# EAGLE schematic Resistor_Resistor (EAGLE 8.3.0), part 13 of 43
## Parts (continued)
R17338  10K  RESISTOR_0201  [0201]
R17339  10K  RESISTOR_0201  [0201]
R17340  10K  RESISTOR_0201  [0201]
R17341  10K  RESISTOR_0201  [0201]
R17342  10K  RESISTOR_0201  [0201]
R17343  10K  RESISTOR_0201  [0201]
R17344  10K  RESISTOR_0201  [0201]
R17345  10K  RESISTOR_0201  [0201]
R17346  10K  RESISTOR_0201  [0201]
R17347  10K  RESISTOR_0201  [0201]
R17348  10K  RESISTOR_0201  [0201]
R17349  10K  RESISTOR_0201  [0201]
R17350  10K  RESISTOR_0201  [0201]
R17351  10K  RESISTOR_0201  [0201]
R17352  10K  RESISTOR_0201  [0201]
R17353  10K  RESISTOR_0201  [0201]
R17354  10K  RESISTOR_0201  [0201]
R17355  10K  RESISTOR_0201  [0201]
R17356  10K  RESISTOR_0201  [0201]
R17357  10K  RESISTOR_0201  [0201]
R17358  10K  RESISTOR_0201  [0201]
R17359  10K  RESISTOR_0201  [0201]
R17360  10K  RESISTOR_0201  [0201]
R17361  10K  RESISTOR_0201  [0201]
R17362  10K  RESISTOR_0201  [0201]
R17363  10K  RESISTOR_0201  [0201]
R17364  10K  RESISTOR_0201  [0201]
R17365  10K  RESISTOR_0201  [0201]
R17366  10K  RESISTOR_0201  [0201]
R17367  10K  RESISTOR_0201  [0201]
R17368  10K  RESISTOR_0201  [0201]
R17369  10K  RESISTOR_0201  [0201]
R17370  10K  RESISTOR_0201  [0201]
R17371  10K  RESISTOR_0201  [0201]
R17372  10K  RESISTOR_0201  [0201]
R17373  10K  RESISTOR_0201  [0201]
R17374  10K  RESISTOR_0201  [0201]
R17375  10K  RESISTOR_0201  [0201]
R17376  10K  RESISTOR_0201  [0201]
R17377  10K  RESISTOR_0201  [0201]
R17378  10K  RESISTOR_0201  [0201]
R17379  10K  RESISTOR_0201  [0201]
R17380  10K  RESISTOR_0201  [0201]
R17381  10K  RESISTOR_0201  [0201]
R17382  10K  RESISTOR_0201  [0201]
R17383  10K  RESISTOR_0201  [0201]
R17384  10K  RESISTOR_0201  [0201]
R17385  10K  RESISTOR_0201  [0201]
R17386  10K  RESISTOR_0201  [0201]
R17387  10K  RESISTOR_0201  [0201]
R17388  10K  RESISTOR_0201  [0201]
R17389  10K  RESISTOR_0201  [0201]
R17390  10K  RESISTOR_0201  [0201]
R17391  10K  RESISTOR_0201  [0201]
R17392  10K  RESISTOR_0201  [0201]
R17393  10K  RESISTOR_0201  [0201]
R17394  10K  RESISTOR_0201  [0201]
R17395  10K  RESISTOR_0201  [0201]
R17396  10K  RESISTOR_0201  [0201]
R17397  10K  RESISTOR_0201  [0201]
R17398  10K  RESISTOR_0201  [0201]
R17399  10K  RESISTOR_0201  [0201]
R17400  10K  RESISTOR_0201  [0201]
R17401  10K  RESISTOR_0201  [0201]
R17402  10K  RESISTOR_0201  [0201]
R17403  10K  RESISTOR_0201  [0201]
R17404  10K  RESISTOR_0201  [0201]
R17405  10K  RESISTOR_0201  [0201]
R17406  10K  RESISTOR_0201  [0201]
R17407  10K  RESISTOR_0201  [0201]
R17408  10K  RESISTOR_0201  [0201]
R17409  10K  RESISTOR_0201  [0201]
R17410  10K  RESISTOR_0201  [0201]
R17411  10K  RESISTOR_0201  [0201]
R17412  10K  RESISTOR_0201  [0201]
R17413  10K  RESISTOR_0201  [0201]
R17414  10K  RESISTOR_0201  [0201]
R17415  10K  RESISTOR_0201  [0201]
R17416  10K  RESISTOR_0201  [0201]
R17417  10K  RESISTOR_0201  [0201]
R17418  10K  RESISTOR_0201  [0201]
R17419  10K  RESISTOR_0201  [0201]
R17420  10K  RESISTOR_0201  [0201]
R17421  10K  RESISTOR_0201  [0201]
R17422  10K  RESISTOR_0201  [0201]
R17423  10K  RESISTOR_0201  [0201]
R17424  10K  RESISTOR_0201  [0201]
R17425  10K  RESISTOR_0201  [0201]
R17426  10K  RESISTOR_0201  [0201]
R17427  10K  RESISTOR_0201  [0201]
R17428  10K  RESISTOR_0201  [0201]
R17429  10K  RESISTOR_0201  [0201]
R17430  10K  RESISTOR_0201  [0201]
R17431  10K  RESISTOR_0201  [0201]
R17432  10K  RESISTOR_0201  [0201]
R17433  10K  RESISTOR_0201  [0201]
R17434  10K  RESISTOR_0201  [0201]
R17435  10K  RESISTOR_0201  [0201]
R17436  10K  RESISTOR_0201  [0201]
R17437  10K  RESISTOR_0201  [0201]
R17438  10K  RESISTOR_0201  [0201]
R17439  10K  RESISTOR_0201  [0201]
R17440  10K  RESISTOR_0201  [0201]
R17441  10K  RESISTOR_0201  [0201]
R17442  10K  RESISTOR_0201  [0201]
R17443  10K  RESISTOR_0201  [0201]
R17444  10K  RESISTOR_0201  [0201]
R17445  10K  RESISTOR_0201  [0201]
R17446  10K  RESISTOR_0201  [0201]
R17447  10K  RESISTOR_0201  [0201]
R17448  10K  RESISTOR_0201  [0201]
R17449  10K  RESISTOR_0201  [0201]
R17450  10K  RESISTOR_0201  [0201]
R17451  10K  RESISTOR_0201  [0201]
R17452  10K  RESISTOR_0201  [0201]
R17453  10K  RESISTOR_0201  [0201]
R17454  10K  RESISTOR_0201  [0201]
R17455  10K  RESISTOR_0201  [0201]
R17456  10K  RESISTOR_0201  [0201]
R17457  10K  RESISTOR_0201  [0201]
R17458  10K  RESISTOR_0201  [0201]
R17459  10K  RESISTOR_0201  [0201]
R17460  10K  RESISTOR_0201  [0201]
R17461  10K  RESISTOR_0201  [0201]
R17462  10K  RESISTOR_0201  [0201]
R17463  10K  RESISTOR_0201  [0201]
R17464  10K  RESISTOR_0201  [0201]
R17465  10K  RESISTOR_0201  [0201]
R17466  10K  RESISTOR_0201  [0201]
R17467  10K  RESISTOR_0201  [0201]
R17468  10K  RESISTOR_0201  [0201]
R17469  10K  RESISTOR_0201  [0201]
R17470  10K  RESISTOR_0201  [0201]
R17471  10K  RESISTOR_0201  [0201]
R17472  10K  RESISTOR_0201  [0201]
R17473  10K  RESISTOR_0201  [0201]
R17474  10K  RESISTOR_0201  [0201]
R17475  10K  RESISTOR_0201  [0201]
R17476  10K  RESISTOR_0201  [0201]
R17477  10K  RESISTOR_0201  [0201]
R17478  10K  RESISTOR_0201  [0201]
R17479  10K  RESISTOR_0201  [0201]
R17480  10K  RESISTOR_0201  [0201]
R17481  10K  RESISTOR_0201  [0201]
R17482  10K  RESISTOR_0201  [0201]
R17483  10K  RESISTOR_0201  [0201]
R17484  10K  RESISTOR_0201  [0201]
R17485  10K  RESISTOR_0201  [0201]
R17486  10K  RESISTOR_0201  [0201]
R17487  10K  RESISTOR_0201  [0201]
R17488  10K  RESISTOR_0201  [0201]
R17489  10K  RESISTOR_0201  [0201]
R17490  10K  RESISTOR_0201  [0201]
R17491  10K  RESISTOR_0201  [0201]
R17492  10K  RESISTOR_0201  [0201]
R17493  10K  RESISTOR_0201  [0201]
R17494  10K  RESISTOR_0201  [0201]
R17495  10K  RESISTOR_0201  [0201]
R17496  10K  RESISTOR_0201  [0201]
R17497  10K  RESISTOR_0201  [0201]
R17498  10K  RESISTOR_0201  [0201]
R17499  10K  RESISTOR_0201  [0201]
R17500  10K  RESISTOR_0201  [0201]
R17501  10K  RESISTOR_0201  [0201]
R17502  10K  RESISTOR_0201  [0201]
R17503  10K  RESISTOR_0201  [0201]
R17504  10K  RESISTOR_0201  [0201]
R17505  10K  RESISTOR_0201  [0201]
R17506  10K  RESISTOR_0201  [0201]
R17507  10K  RESISTOR_0201  [0201]
R17508  10K  RESISTOR_0201  [0201]
R17509  10K  RESISTOR_0201  [0201]
R17510  10K  RESISTOR_0201  [0201]
R17511  10K  RESISTOR_0201  [0201]
R17512  10K  RESISTOR_0201  [0201]
R17513  10K  RESISTOR_0201  [0201]
R17514  10K  RESISTOR_0201  [0201]
R17515  10K  RESISTOR_0201  [0201]
R17516  10K  RESISTOR_0201  [0201]
R17517  10K  RESISTOR_0201  [0201]
R17518  10K  RESISTOR_0201  [0201]
R17519  10K  RESISTOR_0201  [0201]
R17520  10K  RESISTOR_0201  [0201]
R17521  10K  RESISTOR_0201  [0201]
R17522  10K  RESISTOR_0201  [0201]
R17523  10K  RESISTOR_0201  [0201]
R17524  10K  RESISTOR_0201  [0201]
R17525  10K  RESISTOR_0201  [0201]
R17526  10K  RESISTOR_0201  [0201]
R17527  10K  RESISTOR_0201  [0201]
R17528  10K  RESISTOR_0201  [0201]
R17529  10K  RESISTOR_0201  [0201]
R17530  10K  RESISTOR_0201  [0201]
R17531  10K  RESISTOR_0201  [0201]
R17532  10K  RESISTOR_0201  [0201]
R17533  10K  RESISTOR_0201  [0201]
R17534  10K  RESISTOR_0201  [0201]
R17535  10K  RESISTOR_0201  [0201]
R17536  10K  RESISTOR_0201  [0201]
R17537  10K  RESISTOR_0201  [0201]
R17538  10K  RESISTOR_0201  [0201]
R17539  10K  RESISTOR_0201  [0201]
R17540  10K  RESISTOR_0201  [0201]
R17541  10K  RESISTOR_0201  [0201]
R17542  10K  RESISTOR_0201  [0201]
R17543  10K  RESISTOR_0201  [0201]
R17544  10K  RESISTOR_0201  [0201]
R17545  10K  RESISTOR_0201  [0201]
R17546  10K  RESISTOR_0201  [0201]
R17547  10K  RESISTOR_0201  [0201]
R17548  10K  RESISTOR_0201  [0201]
R17549  10K  RESISTOR_0201  [0201]
R17550  10K  RESISTOR_0201  [0201]
R17551  10K  RESISTOR_0201  [0201]
R17552  10K  RESISTOR_0201  [0201]
R17553  10K  RESISTOR_0201  [0201]
R17554  10K  RESISTOR_0201  [0201]
R17555  10K  RESISTOR_0201  [0201]
R17556  10K  RESISTOR_0201  [0201]
R17557  10K  RESISTOR_0201  [0201]
R17558  10K  RESISTOR_0201  [0201]
R17559  10K  RESISTOR_0201  [0201]
R17560  10K  RESISTOR_0201  [0201]
R17561  10K  RESISTOR_0201  [0201]
R17562  10K  RESISTOR_0201  [0201]
R17563  10K  RESISTOR_0201  [0201]
R17564  10K  RESISTOR_0201  [0201]
R17565  10K  RESISTOR_0201  [0201]
R17566  10K  RESISTOR_0201  [0201]
R17567  10K  RESISTOR_0201  [0201]
R17568  10K  RESISTOR_0201  [0201]
R17569  10K  RESISTOR_0201  [0201]
R17570  10K  RESISTOR_0201  [0201]
R17571  10K  RESISTOR_0201  [0201]
R17572  10K  RESISTOR_0201  [0201]
R17573  10K  RESISTOR_0201  [0201]
R17574  10K  RESISTOR_0201  [0201]
R17575  10K  RESISTOR_0201  [0201]
R17576  10K  RESISTOR_0201  [0201]
R17577  10K  RESISTOR_0201  [0201]
R17578  10K  RESISTOR_0201  [0201]
R17579  10K  RESISTOR_0201  [0201]
R17580  10K  RESISTOR_0201  [0201]
R17581  10K  RESISTOR_0201  [0201]
R17582  10K  RESISTOR_0201  [0201]
R17583  10K  RESISTOR_0201  [0201]
R17584  10K  RESISTOR_0201  [0201]
R17585  10K  RESISTOR_0201  [0201]
R17586  10K  RESISTOR_0201  [0201]
R17587  10K  RESISTOR_0201  [0201]
R17588  10K  RESISTOR_0201  [0201]
R17589  10K  RESISTOR_0201  [0201]
R17590  10K  RESISTOR_0201  [0201]
R17591  10K  RESISTOR_0201  [0201]
R17592  10K  RESISTOR_0201  [0201]
R17593  10K  RESISTOR_0201  [0201]
R17594  10K  RESISTOR_0201  [0201]
R17595  10K  RESISTOR_0201  [0201]
R17596  10K  RESISTOR_0201  [0201]
R17597  10K  RESISTOR_0201  [0201]
R17598  10K  RESISTOR_0201  [0201]
R17599  10K  RESISTOR_0201  [0201]
R17600  10K  RESISTOR_0201  [0201]
R17601  10K  RESISTOR_0201  [0201]
R17602  10K  RESISTOR_0201  [0201]
R17603  10K  RESISTOR_0201  [0201]
R17604  10K  RESISTOR_0201  [0201]
R17605  10K  RESISTOR_0201  [0201]
R17606  10K  RESISTOR_0201  [0201]
R17607  10K  RESISTOR_0201  [0201]
R17608  10K  RESISTOR_0201  [0201]
R17609  10K  RESISTOR_0201  [0201]
R17610  10K  RESISTOR_0201  [0201]
R17611  10K  RESISTOR_0201  [0201]
R17612  10K  RESISTOR_0201  [0201]
R17613  10K  RESISTOR_0201  [0201]
R17614  10K  RESISTOR_0201  [0201]
R17615  10K  RESISTOR_0201  [0201]
R17616  10K  RESISTOR_0201  [0201]
R17617  10K  RESISTOR_0201  [0201]
R17618  10K  RESISTOR_0201  [0201]
R17619  10K  RESISTOR_0201  [0201]
R17620  10K  RESISTOR_0201  [0201]
R17621  10K  RESISTOR_0201  [0201]
R17622  10K  RESISTOR_0201  [0201]
R17623  10K  RESISTOR_0201  [0201]
R17624  10K  RESISTOR_0201  [0201]
R17625  10K  RESISTOR_0201  [0201]
R17626  10K  RESISTOR_0201  [0201]
R17627  10K  RESISTOR_0201  [0201]
R17628  10K  RESISTOR_0201  [0201]
R17629  10K  RESISTOR_0201  [0201]
R17630  10K  RESISTOR_0201  [0201]
R17631  10K  RESISTOR_0201  [0201]
R17632  10K  RESISTOR_0201  [0201]
R17633  10K  RESISTOR_0201  [0201]
R17634  10K  RESISTOR_0201  [0201]
R17635  10K  RESISTOR_0201  [0201]
R17636  10K  RESISTOR_0201  [0201]
R17637  10K  RESISTOR_0201  [0201]
R17638  10K  RESISTOR_0201  [0201]
R17639  10K  RESISTOR_0201  [0201]
R17640  10K  RESISTOR_0201  [0201]
R17641  10K  RESISTOR_0201  [0201]
R17642  10K  RESISTOR_0201  [0201]
R17643  10K  RESISTOR_0201  [0201]
R17644  10K  RESISTOR_0201  [0201]
R17645  10K  RESISTOR_0201  [0201]
R17646  10K  RESISTOR_0201  [0201]
R17647  10K  RESISTOR_0201  [0201]
R17648  10K  RESISTOR_0201  [0201]
R17649  10K  RESISTOR_0201  [0201]
R17650  10K  RESISTOR_0201  [0201]
R17651  10K  RESISTOR_0201  [0201]
R17652  10K  RESISTOR_0201  [0201]
R17653  10K  RESISTOR_0201  [0201]
R17654  10K  RESISTOR_0201  [0201]
R17655  10K  RESISTOR_0201  [0201]
R17656  10K  RESISTOR_0201  [0201]
R17657  10K  RESISTOR_0201  [0201]
R17658  10K  RESISTOR_0201  [0201]
R17659  10K  RESISTOR_0201  [0201]
R17660  10K  RESISTOR_0201  [0201]
R17661  10K  RESISTOR_0201  [0201]
R17662  10K  RESISTOR_0201  [0201]
R17663  10K  RESISTOR_0201  [0201]
R17664  10K  RESISTOR_0201  [0201]
R17665  10K  RESISTOR_0201  [0201]
R17666  10K  RESISTOR_0201  [0201]
R17667  10K  RESISTOR_0201  [0201]
R17668  10K  RESISTOR_0201  [0201]
R17669  10K  RESISTOR_0201  [0201]
R17670  10K  RESISTOR_0201  [0201]
R17671  10K  RESISTOR_0201  [0201]
R17672  10K  RESISTOR_0201  [0201]
R17673  10K  RESISTOR_0201  [0201]
R17674  10K  RESISTOR_0201  [0201]
R17675  10K  RESISTOR_0201  [0201]
R17676  10K  RESISTOR_0201  [0201]
R17677  10K  RESISTOR_0201  [0201]
R17678  10K  RESISTOR_0201  [0201]
R17679  10K  RESISTOR_0201  [0201]
R17680  10K  RESISTOR_0201  [0201]
R17681  10K  RESISTOR_0201  [0201]
R17682  10K  RESISTOR_0201  [0201]
R17683  10K  RESISTOR_0201  [0201]
R17684  10K  RESISTOR_0201  [0201]
R17685  10K  RESISTOR_0201  [0201]
R17686  10K  RESISTOR_0201  [0201]
R17687  10K  RESISTOR_0201  [0201]
R17688  10K  RESISTOR_0201  [0201]
R17689  10K  RESISTOR_0201  [0201]
R17690  10K  RESISTOR_0201  [0201]
R17691  10K  RESISTOR_0201  [0201]
R17692  10K  RESISTOR_0201  [0201]
R17693  10K  RESISTOR_0201  [0201]
R17694  10K  RESISTOR_0201  [0201]
R17695  10K  RESISTOR_0201  [0201]
R17696  10K  RESISTOR_0201  [0201]
R17697  10K  RESISTOR_0201  [0201]
R17698  10K  RESISTOR_0201  [0201]
R17699  10K  RESISTOR_0201  [0201]
R17700  10K  RESISTOR_0201  [0201]
R17701  10K  RESISTOR_0201  [0201]
R17702  10K  RESISTOR_0201  [0201]
R17703  10K  RESISTOR_0201  [0201]
R17704  10K  RESISTOR_0201  [0201]
R17705  10K  RESISTOR_0201  [0201]
R17706  10K  RESISTOR_0201  [0201]
R17707  10K  RESISTOR_0201  [0201]
R17708  10K  RESISTOR_0201  [0201]
R17709  10K  RESISTOR_0201  [0201]
R17710  10K  RESISTOR_0201  [0201]
R17711  10K  RESISTOR_0201  [0201]
R17712  10K  RESISTOR_0201  [0201]
R17713  10K  RESISTOR_0201  [0201]
R17714  10K  RESISTOR_0201  [0201]
R17715  10K  RESISTOR_0201  [0201]
R17716  10K  RESISTOR_0201  [0201]
R17717  10K  RESISTOR_0201  [0201]
R17718  10K  RESISTOR_0201  [0201]
R17719  10K  RESISTOR_0201  [0201]
R17720  10K  RESISTOR_0201  [0201]
R17721  10K  RESISTOR_0201  [0201]
R17722  10K  RESISTOR_0201  [0201]
R17723  10K  RESISTOR_0201  [0201]
R17724  10K  RESISTOR_0201  [0201]
R17725  10K  RESISTOR_0201  [0201]
R17726  10K  RESISTOR_0201  [0201]
R17727  10K  RESISTOR_0201  [0201]
R17728  10K  RESISTOR_0201  [0201]
R17729  10K  RESISTOR_0201  [0201]
R17730  10K  RESISTOR_0201  [0201]
R17731  10K  RESISTOR_0201  [0201]
R17732  10K  RESISTOR_0201  [0201]
R17733  10K  RESISTOR_0201  [0201]
R17734  10K  RESISTOR_0201  [0201]
R17735  10K  RESISTOR_0201  [0201]
R17736  10K  RESISTOR_0201  [0201]
R17737  10K  RESISTOR_0201  [0201]
R17738  10K  RESISTOR_0201  [0201]
R17739  10K  RESISTOR_0201  [0201]
R17740  10K  RESISTOR_0201  [0201]
R17741  10K  RESISTOR_0201  [0201]
R17742  10K  RESISTOR_0201  [0201]
R17743  10K  RESISTOR_0201  [0201]
R17744  10K  RESISTOR_0201  [0201]
R17745  10K  RESISTOR_0201  [0201]
R17746  10K  RESISTOR_0201  [0201]
R17747  10K  RESISTOR_0201  [0201]
R17748  10K  RESISTOR_0201  [0201]
R17749  10K  RESISTOR_0201  [0201]
R17750  10K  RESISTOR_0201  [0201]
R17751  10K  RESISTOR_0201  [0201]
R17752  10K  RESISTOR_0201  [0201]
R17753  10K  RESISTOR_0201  [0201]
R17754  10K  RESISTOR_0201  [0201]
R17755  10K  RESISTOR_0201  [0201]
R17756  10K  RESISTOR_0201  [0201]
R17757  10K  RESISTOR_0201  [0201]
R17758  10K  RESISTOR_0201  [0201]
R17759  10K  RESISTOR_0201  [0201]
R17760  10K  RESISTOR_0201  [0201]
R17761  10K  RESISTOR_0201  [0201]
R17762  10K  RESISTOR_0201  [0201]
R17763  10K  RESISTOR_0201  [0201]
R17764  10K  RESISTOR_0201  [0201]
R17765  10K  RESISTOR_0201  [0201]
R17766  10K  RESISTOR_0201  [0201]
R17767  10K  RESISTOR_0201  [0201]
R17768  10K  RESISTOR_0201  [0201]
R17769  10K  RESISTOR_0201  [0201]
R17770  10K  RESISTOR_0201  [0201]
R17771  10K  RESISTOR_0201  [0201]
R17772  10K  RESISTOR_0201  [0201]
R17773  10K  RESISTOR_0201  [0201]
R17774  10K  RESISTOR_0201  [0201]
R17775  10K  RESISTOR_0201  [0201]
R17776  10K  RESISTOR_0201  [0201]
R17777  10K  RESISTOR_0201  [0201]
R17778  10K  RESISTOR_0201  [0201]
R17779  10K  RESISTOR_0201  [0201]
R17780  10K  RESISTOR_0201  [0201]
R17781  10K  RESISTOR_0201  [0201]
R17782  10K  RESISTOR_0201  [0201]
R17783  10K  RESISTOR_0201  [0201]
R17784  10K  RESISTOR_0201  [0201]
R17785  10K  RESISTOR_0201  [0201]
R17786  10K  RESISTOR_0201  [0201]
R17787  10K  RESISTOR_0201  [0201]
R17788  10K  RESISTOR_0201  [0201]
R17789  10K  RESISTOR_0201  [0201]
R17790  10K  RESISTOR_0201  [0201]
R17791  10K  RESISTOR_0201  [0201]
R17792  10K  RESISTOR_0201  [0201]
R17793  10K  RESISTOR_0201  [0201]
R17794  10K  RESISTOR_0201  [0201]
R17795  10K  RESISTOR_0201  [0201]
R17796  10K  RESISTOR_0201  [0201]
R17797  10K  RESISTOR_0201  [0201]
R17798  10K  RESISTOR_0201  [0201]
R17799  10K  RESISTOR_0201  [0201]
R17800  10K  RESISTOR_0201  [0201]
R17801  10K  RESISTOR_0201  [0201]
R17802  10K  RESISTOR_0201  [0201]
R17803  10K  RESISTOR_0201  [0201]
R17804  10K  RESISTOR_0201  [0201]
R17805  10K  RESISTOR_0201  [0201]
R17806  10K  RESISTOR_0201  [0201]
R17807  10K  RESISTOR_0201  [0201]
R17808  10K  RESISTOR_0201  [0201]
R17809  10K  RESISTOR_0201  [0201]
R17810  10K  RESISTOR_0201  [0201]
R17811  10K  RESISTOR_0201  [0201]
R17812  10K  RESISTOR_0201  [0201]
R17813  10K  RESISTOR_0201  [0201]
R17814  10K  RESISTOR_0201  [0201]
R17815  10K  RESISTOR_0201  [0201]
R17816  10K  RESISTOR_0201  [0201]
R17817  10K  RESISTOR_0201  [0201]
R17818  10K  RESISTOR_0201  [0201]
R17819  10K  RESISTOR_0201  [0201]
R17820  10K  RESISTOR_0201  [0201]
R17821  10K  RESISTOR_0201  [0201]
R17822  10K  RESISTOR_0201  [0201]
R17823  10K  RESISTOR_0201  [0201]
R17824  10K  RESISTOR_0201  [0201]
R17825  10K  RESISTOR_0201  [0201]
R17826  10K  RESISTOR_0201  [0201]
R17827  10K  RESISTOR_0201  [0201]
R17828  10K  RESISTOR_0201  [0201]
R17829  10K  RESISTOR_0201  [0201]
R17830  10K  RESISTOR_0201  [0201]
R17831  10K  RESISTOR_0201  [0201]
R17832  10K  RESISTOR_0201  [0201]
R17833  10K  RESISTOR_0201  [0201]
R17834  10K  RESISTOR_0201  [0201]
R17835  10K  RESISTOR_0201  [0201]
R17836  10K  RESISTOR_0201  [0201]
R17837  10K  RESISTOR_0201  [0201]
R17838  10K  RESISTOR_0201  [0201]
R17839  10K  RESISTOR_0201  [0201]
R17840  10K  RESISTOR_0201  [0201]
R17841  10K  RESISTOR_0201  [0201]
R17842  10K  RESISTOR_0201  [0201]
R17843  10K  RESISTOR_0201  [0201]
R17844  10K  RESISTOR_0201  [0201]
R17845  10K  RESISTOR_0201  [0201]
R17846  10K  RESISTOR_0201  [0201]
R17847  10K  RESISTOR_0201  [0201]
R17848  10K  RESISTOR_0201  [0201]
R17849  10K  RESISTOR_0201  [0201]
R17850  10K  RESISTOR_0201  [0201]
R17851  10K  RESISTOR_0201  [0201]
R17852  10K  RESISTOR_0201  [0201]
R17853  10K  RESISTOR_0201  [0201]
R17854  10K  RESISTOR_0201  [0201]
R17855  10K  RESISTOR_0201  [0201]
R17856  10K  RESISTOR_0201  [0201]
R17857  10K  RESISTOR_0201  [0201]
R17858  10K  RESISTOR_0201  [0201]
R17859  10K  RESISTOR_0201  [0201]
R17860  10K  RESISTOR_0201  [0201]
R17861  10K  RESISTOR_0201  [0201]
R17862  10K  RESISTOR_0201  [0201]
R17863  10K  RESISTOR_0201  [0201]
R17864  10K  RESISTOR_0201  [0201]
R17865  10K  RESISTOR_0201  [0201]
R17866  10K  RESISTOR_0201  [0201]
R17867  10K  RESISTOR_0201  [0201]
R17868  10K  RESISTOR_0201  [0201]
R17869  10K  RESISTOR_0201  [0201]
R17870  10K  RESISTOR_0201  [0201]
R17871  10K  RESISTOR_0201  [0201]
R17872  10K  RESISTOR_0201  [0201]
R17873  10K  RESISTOR_0201  [0201]
R17874  10K  RESISTOR_0201  [0201]
R17875  10K  RESISTOR_0201  [0201]
R17876  10K  RESISTOR_0201  [0201]
R17877  10K  RESISTOR_0201  [0201]
R17878  10K  RESISTOR_0201  [0201]
R17879  10K  RESISTOR_0201  [0201]
R17880  10K  RESISTOR_0201  [0201]
R17881  10K  RESISTOR_0201  [0201]
R17882  10K  RESISTOR_0201  [0201]
R17883  10K  RESISTOR_0201  [0201]
R17884  10K  RESISTOR_0201  [0201]
R17885  10K  RESISTOR_0201  [0201]
R17886  10K  RESISTOR_0201  [0201]
R17887  10K  RESISTOR_0201  [0201]
R17888  10K  RESISTOR_0201  [0201]
R17889  10K  RESISTOR_0201  [0201]
R17890  10K  RESISTOR_0201  [0201]
R17891  10K  RESISTOR_0201  [0201]
R17892  10K  RESISTOR_0201  [0201]
R17893  10K  RESISTOR_0201  [0201]
R17894  10K  RESISTOR_0201  [0201]
R17895  10K  RESISTOR_0201  [0201]
R17896  10K  RESISTOR_0201  [0201]
R17897  10K  RESISTOR_0201  [0201]
R17898  10K  RESISTOR_0201  [0201]
R17899  10K  RESISTOR_0201  [0201]
R17900  10K  RESISTOR_0201  [0201]
R17901  10K  RESISTOR_0201  [0201]
R17902  10K  RESISTOR_0201  [0201]
R17903  10K  RESISTOR_0201  [0201]
R17904  10K  RESISTOR_0201  [0201]
R17905  10K  RESISTOR_0201  [0201]
R17906  10K  RESISTOR_0201  [0201]
R17907  10K  RESISTOR_0201  [0201]
R17908  10K  RESISTOR_0201  [0201]
R17909  10K  RESISTOR_0201  [0201]
R17910  10K  RESISTOR_0201  [0201]
R17911  10K  RESISTOR_0201  [0201]
R17912  10K  RESISTOR_0201  [0201]
R17913  10K  RESISTOR_0201  [0201]
R17914  10K  RESISTOR_0201  [0201]
R17915  10K  RESISTOR_0201  [0201]
R17916  10K  RESISTOR_0201  [0201]
R17917  10K  RESISTOR_0201  [0201]
R17918  10K  RESISTOR_0201  [0201]
R17919  10K  RESISTOR_0201  [0201]
R17920  10K  RESISTOR_0201  [0201]
R17921  10K  RESISTOR_0201  [0201]
R17922  10K  RESISTOR_0201  [0201]
R17923  10K  RESISTOR_0201  [0201]
R17924  10K  RESISTOR_0201  [0201]
R17925  10K  RESISTOR_0201  [0201]
R17926  10K  RESISTOR_0201  [0201]
R17927  10K  RESISTOR_0201  [0201]
R17928  10K  RESISTOR_0201  [0201]
R17929  10K  RESISTOR_0201  [0201]
R17930  10K  RESISTOR_0201  [0201]
R17931  10K  RESISTOR_0201  [0201]
R17932  10K  RESISTOR_0201  [0201]
R17933  10K  RESISTOR_0201  [0201]
R17934  10K  RESISTOR_0201  [0201]
R17935  10K  RESISTOR_0201  [0201]
R17936  10K  RESISTOR_0201  [0201]
R17937  10K  RESISTOR_0201  [0201]
R17938  10K  RESISTOR_0201  [0201]
R17939  10K  RESISTOR_0201  [0201]
R17940  10K  RESISTOR_0201  [0201]
R17941  10K  RESISTOR_0201  [0201]
R17942  10K  RESISTOR_0201  [0201]
R17943  10K  RESISTOR_0201  [0201]
R17944  10K  RESISTOR_0201  [0201]
R17945  10K  RESISTOR_0201  [0201]
R17946  10K  RESISTOR_0201  [0201]
R17947  10K  RESISTOR_0201  [0201]
R17948  10K  RESISTOR_0201  [0201]
R17949  10K  RESISTOR_0201  [0201]
R17950  10K  RESISTOR_0201  [0201]
R17951  10K  RESISTOR_0201  [0201]
R17952  10K  RESISTOR_0201  [0201]
R17953  10K  RESISTOR_0201  [0201]
R17954  10K  RESISTOR_0201  [0201]
R17955  10K  RESISTOR_0201  [0201]
R17956  10K  RESISTOR_0201  [0201]
R17957  10K  RESISTOR_0201  [0201]
R17958  10K  RESISTOR_0201  [0201]
R17959  10K  RESISTOR_0201  [0201]
R17960  10K  RESISTOR_0201  [0201]
R17961  10K  RESISTOR_0201  [0201]
R17962  10K  RESISTOR_0201  [0201]
R17963  10K  RESISTOR_0201  [0201]
R17964  10K  RESISTOR_0201  [0201]
R17965  10K  RESISTOR_0201  [0201]
R17966  10K  RESISTOR_0201  [0201]
R17967  10K  RESISTOR_0201  [0201]
R17968  10K  RESISTOR_0201  [0201]
R17969  10K  RESISTOR_0201  [0201]
R17970  10K  RESISTOR_0201  [0201]
R17971  10K  RESISTOR_0201  [0201]
R17972  10K  RESISTOR_0201  [0201]
R17973  10K  RESISTOR_0201  [0201]
R17974  10K  RESISTOR_0201  [0201]
R17975  10K  RESISTOR_0201  [0201]
R17976  10K  RESISTOR_0201  [0201]
R17977  10K  RESISTOR_0201  [0201]
R17978  10K  RESISTOR_0201  [0201]
R17979  10K  RESISTOR_0201  [0201]
R17980  10K  RESISTOR_0201  [0201]
R17981  10K  RESISTOR_0201  [0201]
R17982  10K  RESISTOR_0201  [0201]
R17983  10K  RESISTOR_0201  [0201]
R17984  10K  RESISTOR_0201  [0201]
R17985  10K  RESISTOR_0201  [0201]
R17986  10K  RESISTOR_0201  [0201]
R17987  10K  RESISTOR_0201  [0201]
R17988  10K  RESISTOR_0201  [0201]
R17989  10K  RESISTOR_0201  [0201]
R17990  10K  RESISTOR_0201  [0201]
R17991  10K  RESISTOR_0201  [0201]
R17992  10K  RESISTOR_0201  [0201]
R17993  10K  RESISTOR_0201  [0201]
R17994  10K  RESISTOR_0201  [0201]
R17995  10K  RESISTOR_0201  [0201]
R17996  10K  RESISTOR_0201  [0201]
R17997  10K  RESISTOR_0201  [0201]
R17998  10K  RESISTOR_0201  [0201]
R17999  10K  RESISTOR_0201  [0201]
R18000  10K  RESISTOR_0201  [0201]
R18001  10K  RESISTOR_0201  [0201]
R18002  10K  RESISTOR_0201  [0201]
R18003  10K  RESISTOR_0201  [0201]
R18004  10K  RESISTOR_0201  [0201]
R18005  10K  RESISTOR_0201  [0201]
R18006  10K  RESISTOR_0201  [0201]
R18007  10K  RESISTOR_0201  [0201]
R18008  10K  RESISTOR_0201  [0201]
R18009  10K  RESISTOR_0201  [0201]
R18010  10K  RESISTOR_0201  [0201]
R18011  10K  RESISTOR_0201  [0201]
R18012  10K  RESISTOR_0201  [0201]
R18013  10K  RESISTOR_0201  [0201]
R18014  10K  RESISTOR_0201  [0201]
R18015  10K  RESISTOR_0201  [0201]
R18016  10K  RESISTOR_0201  [0201]
R18017  10K  RESISTOR_0201  [0201]
R18018  10K  RESISTOR_0201  [0201]
R18019  10K  RESISTOR_0201  [0201]
R18020  10K  RESISTOR_0201  [0201]
R18021  10K  RESISTOR_0201  [0201]
R18022  10K  RESISTOR_0201  [0201]
R18023  10K  RESISTOR_0201  [0201]
R18024  10K  RESISTOR_0201  [0201]
R18025  10K  RESISTOR_0201  [0201]
R18026  10K  RESISTOR_0201  [0201]
R18027  10K  RESISTOR_0201  [0201]
R18028  10K  RESISTOR_0201  [0201]
R18029  10K  RESISTOR_0201  [0201]
R18030  10K  RESISTOR_0201  [0201]
R18031  10K  RESISTOR_0201  [0201]
R18032  10K  RESISTOR_0201  [0201]
R18033  10K  RESISTOR_0201  [0201]
R18034  10K  RESISTOR_0201  [0201]
R18035  10K  RESISTOR_0201  [0201]
R18036  10K  RESISTOR_0201  [0201]
R18037  10K  RESISTOR_0201  [0201]
R18038  10K  RESISTOR_0201  [0201]
R18039  10K  RESISTOR_0201  [0201]
R18040  10K  RESISTOR_0201  [0201]
R18041  10K  RESISTOR_0201  [0201]
R18042  10K  RESISTOR_0201  [0201]
R18043  10K  RESISTOR_0201  [0201]
R18044  10K  RESISTOR_0201  [0201]
R18045  10K  RESISTOR_0201  [0201]
R18046  10K  RESISTOR_0201  [0201]
R18047  10K  RESISTOR_0201  [0201]
R18048  10K  RESISTOR_0201  [0201]
R18049  10K  RESISTOR_0201  [0201]
R18050  10K  RESISTOR_0201  [0201]
R18051  10K  RESISTOR_0201  [0201]
R18052  10K  RESISTOR_0201  [0201]
R18053  10K  RESISTOR_0201  [0201]
R18054  10K  RESISTOR_0201  [0201]
R18055  10K  RESISTOR_0201  [0201]
R18056  10K  RESISTOR_0201  [0201]
R18057  10K  RESISTOR_0201  [0201]
R18058  10K  RESISTOR_0201  [0201]
R18059  10K  RESISTOR_0201  [0201]
R18060  10K  RESISTOR_0201  [0201]
R18061  10K  RESISTOR_0201  [0201]
R18062  10K  RESISTOR_0201  [0201]
R18063  10K  RESISTOR_0201  [0201]
R18064  10K  RESISTOR_0201  [0201]
R18065  10K  RESISTOR_0201  [0201]
R18066  10K  RESISTOR_0201  [0201]
R18067  10K  RESISTOR_0201  [0201]
R18068  10K  RESISTOR_0201  [0201]
R18069  10K  RESISTOR_0201  [0201]
R18070  10K  RESISTOR_0201  [0201]
R18071  10K  RESISTOR_0201  [0201]
R18072  10K  RESISTOR_0201  [0201]
R18073  10K  RESISTOR_0201  [0201]
R18074  10K  RESISTOR_0201  [0201]
R18075  10K  RESISTOR_0201  [0201]
R18076  10K  RESISTOR_0201  [0201]
R18077  10K  RESISTOR_0201  [0201]
R18078  10K  RESISTOR_0201  [0201]
R18079  10K  RESISTOR_0201  [0201]
R18080  10K  RESISTOR_0201  [0201]
R18081  10K  RESISTOR_0201  [0201]
R18082  10K  RESISTOR_0201  [0201]
R18083  10K  RESISTOR_0201  [0201]
R18084  10K  RESISTOR_0201  [0201]
R18085  10K  RESISTOR_0201  [0201]
R18086  10K  RESISTOR_0201  [0201]
R18087  10K  RESISTOR_0201  [0201]
R18088  10K  RESISTOR_0201  [0201]
R18089  10K  RESISTOR_0201  [0201]
R18090  10K  RESISTOR_0201  [0201]
R18091  10K  RESISTOR_0201  [0201]
R18092  10K  RESISTOR_0201  [0201]
R18093  10K  RESISTOR_0201  [0201]
R18094  10K  RESISTOR_0201  [0201]
R18095  10K  RESISTOR_0201  [0201]
R18096  10K  RESISTOR_0201  [0201]
R18097  10K  RESISTOR_0201  [0201]
R18098  10K  RESISTOR_0201  [0201]
R18099  10K  RESISTOR_0201  [0201]
R18100  10K  RESISTOR_0201  [0201]
R18101  10K  RESISTOR_0201  [0201]
R18102  10K  RESISTOR_0201  [0201]
R18103  10K  RESISTOR_0201  [0201]
R18104  10K  RESISTOR_0201  [0201]
R18105  10K  RESISTOR_0201  [0201]
R18106  10K  RESISTOR_0201  [0201]
R18107  10K  RESISTOR_0201  [0201]
R18108  10K  RESISTOR_0201  [0201]
R18109  10K  RESISTOR_0201  [0201]
R18110  10K  RESISTOR_0201  [0201]
R18111  10K  RESISTOR_0201  [0201]
R18112  10K  RESISTOR_0201  [0201]
R18113  10K  RESISTOR_0201  [0201]
R18114  10K  RESISTOR_0201  [0201]
R18115  10K  RESISTOR_0201  [0201]
R18116  10K  RESISTOR_0201  [0201]
R18117  10K  RESISTOR_0201  [0201]
R18118  10K  RESISTOR_0201  [0201]
R18119  10K  RESISTOR_0201  [0201]
R18120  10K  RESISTOR_0201  [0201]
R18121  10K  RESISTOR_0201  [0201]
R18122  10K  RESISTOR_0201  [0201]
R18123  10K  RESISTOR_0201  [0201]
R18124  10K  RESISTOR_0201  [0201]
R18125  10K  RESISTOR_0201  [0201]
R18126  10K  RESISTOR_0201  [0201]
R18127  10K  RESISTOR_0201  [0201]
R18128  10K  RESISTOR_0201  [0201]
R18129  10K  RESISTOR_0201  [0201]
R18130  10K  RESISTOR_0201  [0201]
R18131  10K  RESISTOR_0201  [0201]
R18132  10K  RESISTOR_0201  [0201]
R18133  10K  RESISTOR_0201  [0201]
R18134  10K  RESISTOR_0201  [0201]
R18135  10K  RESISTOR_0201  [0201]
R18136  10K  RESISTOR_0201  [0201]
R18137  10K  RESISTOR_0201  [0201]
R18138  10K  RESISTOR_0201  [0201]
R18139  10K  RESISTOR_0201  [0201]
R18140  10K  RESISTOR_0201  [0201]
R18141  10K  RESISTOR_0201  [0201]
R18142  10K  RESISTOR_0201  [0201]
R18143  10K  RESISTOR_0201  [0201]
R18144  10K  RESISTOR_0201  [0201]
R18145  10K  RESISTOR_0201  [0201]
R18146  10K  RESISTOR_0201  [0201]
R18147  10K  RESISTOR_0201  [0201]
R18148  10K  RESISTOR_0201  [0201]
R18149  10K  RESISTOR_0201  [0201]
R18150  10K  RESISTOR_0201  [0201]
R18151  10K  RESISTOR_0201  [0201]
R18152  10K  RESISTOR_0201  [0201]
R18153  10K  RESISTOR_0201  [0201]
R18154  10K  RESISTOR_0201  [0201]
R18155  10K  RESISTOR_0201  [0201]
R18156  10K  RESISTOR_0201  [0201]
R18157  10K  RESISTOR_0201  [0201]
R18158  10K  RESISTOR_0201  [0201]
R18159  10K  RESISTOR_0201  [0201]
R18160  10K  RESISTOR_0201  [0201]
R18161  10K  RESISTOR_0201  [0201]
R18162  10K  RESISTOR_0201  [0201]
R18163  10K  RESISTOR_0201  [0201]
R18164  10K  RESISTOR_0201  [0201]
R18165  10K  RESISTOR_0201  [0201]
R18166  10K  RESISTOR_0201  [0201]
R18167  10K  RESISTOR_0201  [0201]
R18168  10K  RESISTOR_0201  [0201]
R18169  10K  RESISTOR_0201  [0201]
R18170  10K  RESISTOR_0201  [0201]
R18171  10K  RESISTOR_0201  [0201]
R18172  10K  RESISTOR_0201  [0201]
R18173  10K  RESISTOR_0201  [0201]
R18174  10K  RESISTOR_0201  [0201]
R18175  10K  RESISTOR_0201  [0201]
R18176  10K  RESISTOR_0201  [0201]
R18177  10K  RESISTOR_0201  [0201]
R18178  10K  RESISTOR_0201  [0201]
R18179  10K  RESISTOR_0201  [0201]
R18180  10K  RESISTOR_0201  [0201]
R18181  10K  RESISTOR_0201  [0201]
R18182  10K  RESISTOR_0201  [0201]
R18183  10K  RESISTOR_0201  [0201]
R18184  10K  RESISTOR_0201  [0201]
R18185  10K  RESISTOR_0201  [0201]
R18186  10K  RESISTOR_0201  [0201]
R18187  10K  RESISTOR_0201  [0201]
R18188  10K  RESISTOR_0201  [0201]
R18189  10K  RESISTOR_0201  [0201]
R18190  10K  RESISTOR_0201  [0201]
R18191  10K  RESISTOR_0201  [0201]
R18192  10K  RESISTOR_0201  [0201]
R18193  10K  RESISTOR_0201  [0201]
R18194  10K  RESISTOR_0201  [0201]
R18195  10K  RESISTOR_0201  [0201]
R18196  10K  RESISTOR_0201  [0201]
R18197  10K  RESISTOR_0201  [0201]
R18198  10K  RESISTOR_0201  [0201]
R18199  10K  RESISTOR_0201  [0201]
R18200  10K  RESISTOR_0201  [0201]
R18201  10K  RESISTOR_0201  [0201]
R18202  10K  RESISTOR_0201  [0201]
R18203  10K  RESISTOR_0201  [0201]
R18204  10K  RESISTOR_0201  [0201]
R18205  10K  RESISTOR_0201  [0201]
R18206  10K  RESISTOR_0201  [0201]
R18207  10K  RESISTOR_0201  [0201]
R18208  10K  RESISTOR_0201  [0201]
R18209  10K  RESISTOR_0201  [0201]
R18210  10K  RESISTOR_0201  [0201]
R18211  10K  RESISTOR_0201  [0201]
R18212  10K  RESISTOR_0201  [0201]
R18213  10K  RESISTOR_0201  [0201]
R18214  10K  RESISTOR_0201  [0201]
R18215  10K  RESISTOR_0201  [0201]
R18216  10K  RESISTOR_0201  [0201]
R18217  10K  RESISTOR_0201  [0201]
R18218  10K  RESISTOR_0201  [0201]
R18219  10K  RESISTOR_0201  [0201]
R18220  10K  RESISTOR_0201  [0201]
R18221  10K  RESISTOR_0201  [0201]
R18222  10K  RESISTOR_0201  [0201]
R18223  10K  RESISTOR_0201  [0201]
R18224  10K  RESISTOR_0201  [0201]
R18225  10K  RESISTOR_0201  [0201]
R18226  10K  RESISTOR_0201  [0201]
R18227  10K  RESISTOR_0201  [0201]
R18228  10K  RESISTOR_0201  [0201]
R18229  10K  RESISTOR_0201  [0201]
R18230  10K  RESISTOR_0201  [0201]
R18231  10K  RESISTOR_0201  [0201]
R18232  10K  RESISTOR_0201  [0201]
R18233  10K  RESISTOR_0201  [0201]
R18234  10K  RESISTOR_0201  [0201]
R18235  10K  RESISTOR_0201  [0201]
R18236  10K  RESISTOR_0201  [0201]
R18237  10K  RESISTOR_0201  [0201]
R18238  10K  RESISTOR_0201  [0201]
R18239  10K  RESISTOR_0201  [0201]
R18240  10K  RESISTOR_0201  [0201]
R18241  10K  RESISTOR_0201  [0201]
R18242  10K  RESISTOR_0201  [0201]
R18243  10K  RESISTOR_0201  [0201]
R18244  10K  RESISTOR_0201  [0201]
R18245  10K  RESISTOR_0201  [0201]
R18246  10K  RESISTOR_0201  [0201]
R18247  10K  RESISTOR_0201  [0201]
R18248  10K  RESISTOR_0201  [0201]
R18249  10K  RESISTOR_0201  [0201]
R18250  10K  RESISTOR_0201  [0201]
R18251  10K  RESISTOR_0201  [0201]
R18252  10K  RESISTOR_0201  [0201]
R18253  10K  RESISTOR_0201  [0201]
R18254  10K  RESISTOR_0201  [0201]
R18255  10K  RESISTOR_0201  [0201]
R18256  10K  RESISTOR_0201  [0201]
R18257  10K  RESISTOR_0201  [0201]
R18258  10K  RESISTOR_0201  [0201]
R18259  10K  RESISTOR_0201  [0201]
R18260  10K  RESISTOR_0201  [0201]
R18261  10K  RESISTOR_0201  [0201]
R18262  10K  RESISTOR_0201  [0201]
R18263  10K  RESISTOR_0201  [0201]
R18264  10K  RESISTOR_0201  [0201]
R18265  10K  RESISTOR_0201  [0201]
R18266  10K  RESISTOR_0201  [0201]
R18267  10K  RESISTOR_0201  [0201]
R18268  10K  RESISTOR_0201  [0201]
R18269  10K  RESISTOR_0201  [0201]
R18270  10K  RESISTOR_0201  [0201]
R18271  10K  RESISTOR_0201  [0201]
R18272  10K  RESISTOR_0201  [0201]
R18273  10K  RESISTOR_0201  [0201]
R18274  10K  RESISTOR_0201  [0201]
R18275  10K  RESISTOR_0201  [0201]
R18276  10K  RESISTOR_0201  [0201]
R18277  10K  RESISTOR_0201  [0201]
R18278  10K  RESISTOR_0201  [0201]
R18279  10K  RESISTOR_0201  [0201]
R18280  10K  RESISTOR_0201  [0201]
R18281  10K  RESISTOR_0201  [0201]
R18282  10K  RESISTOR_0201  [0201]
R18283  10K  RESISTOR_0201  [0201]
R18284  10K  RESISTOR_0201  [0201]
R18285  10K  RESISTOR_0201  [0201]
R18286  10K  RESISTOR_0201  [0201]
R18287  10K  RESISTOR_0201  [0201]
R18288  10K  RESISTOR_0201  [0201]
R18289  10K  RESISTOR_0201  [0201]
R18290  10K  RESISTOR_0201  [0201]
R18291  10K  RESISTOR_0201  [0201]
R18292  10K  RESISTOR_0201  [0201]
R18293  10K  RESISTOR_0201  [0201]
R18294  10K  RESISTOR_0201  [0201]
R18295  10K  RESISTOR_0201  [0201]
R18296  10K  RESISTOR_0201  [0201]
R18297  10K  RESISTOR_0201  [0201]
R18298  10K  RESISTOR_0201  [0201]
R18299  10K  RESISTOR_0201  [0201]
R18300  10K  RESISTOR_0201  [0201]
R18301  10K  RESISTOR_0201  [0201]
R18302  10K  RESISTOR_0201  [0201]
R18303  10K  RESISTOR_0201  [0201]
R18304  10K  RESISTOR_0201  [0201]
R18305  10K  RESISTOR_0201  [0201]
R18306  10K  RESISTOR_0201  [0201]
R18307  10K  RESISTOR_0201  [0201]
R18308  10K  RESISTOR_0201  [0201]
R18309  10K  RESISTOR_0201  [0201]
R18310  10K  RESISTOR_0201  [0201]
R18311  10K  RESISTOR_0201  [0201]
R18312  10K  RESISTOR_0201  [0201]
R18313  10K  RESISTOR_0201  [0201]
R18314  10K  RESISTOR_0201  [0201]
R18315  10K  RESISTOR_0201  [0201]
R18316  10K  RESISTOR_0201  [0201]
R18317  10K  RESISTOR_0201  [0201]
R18318  10K  RESISTOR_0201  [0201]
R18319  10K  RESISTOR_0201  [0201]
R18320  10K  RESISTOR_0201  [0201]
R18321  10K  RESISTOR_0201  [0201]
R18322  10K  RESISTOR_0201  [0201]
R18323  10K  RESISTOR_0201  [0201]
R18324  10K  RESISTOR_0201  [0201]
R18325  10K  RESISTOR_0201  [0201]
R18326  10K  RESISTOR_0201  [0201]
R18327  10K  RESISTOR_0201  [0201]
R18328  10K  RESISTOR_0201  [0201]
R18329  10K  RESISTOR_0201  [0201]
R18330  10K  RESISTOR_0201  [0201]
R18331  10K  RESISTOR_0201  [0201]
R18332  10K  RESISTOR_0201  [0201]
R18333  10K  RESISTOR_0201  [0201]
R18334  10K  RESISTOR_0201  [0201]
R18335  10K  RESISTOR_0201  [0201]
R18336  10K  RESISTOR_0201  [0201]
R18337  10K  RESISTOR_0201  [0201]
R18338  10K  RESISTOR_0201  [0201]
R18339  10K  RESISTOR_0201  [0201]
R18340  10K  RESISTOR_0201  [0201]
R18341  10K  RESISTOR_0201  [0201]
R18342  10K  RESISTOR_0201  [0201]
R18343  10K  RESISTOR_0201  [0201]
R18344  10K  RESISTOR_0201  [0201]
R18345  10K  RESISTOR_0201  [0201]
R18346  10K  RESISTOR_0201  [0201]
R18347  10K  RESISTOR_0201  [0201]
R18348  10K  RESISTOR_0201  [0201]
R18349  10K  RESISTOR_0201  [0201]
R18350  10K  RESISTOR_0201  [0201]
R18351  10K  RESISTOR_0201  [0201]
R18352  10K  RESISTOR_0201  [0201]
R18353  10K  RESISTOR_0201  [0201]
R18354  10K  RESISTOR_0201  [0201]
R18355  10K  RESISTOR_0201  [0201]
R18356  10K  RESISTOR_0201  [0201]
R18357  10K  RESISTOR_0201  [0201]
R18358  10K  RESISTOR_0201  [0201]
R18359  10K  RESISTOR_0201  [0201]
R18360  10K  RESISTOR_0201  [0201]
R18361  10K  RESISTOR_0201  [0201]
R18362  10K  RESISTOR_0201  [0201]
R18363  10K  RESISTOR_0201  [0201]
R18364  10K  RESISTOR_0201  [0201]
R18365  10K  RESISTOR_0201  [0201]
R18366  10K  RESISTOR_0201  [0201]
R18367  10K  RESISTOR_0201  [0201]
R18368  10K  RESISTOR_0201  [0201]
R18369  10K  RESISTOR_0201  [0201]
R18370  10K  RESISTOR_0201  [0201]
R18371  10K  RESISTOR_0201  [0201]
R18372  10K  RESISTOR_0201  [0201]
R18373  10K  RESISTOR_0201  [0201]
R18374  10K  RESISTOR_0201  [0201]
R18375  10K  RESISTOR_0201  [0201]
R18376  10K  RESISTOR_0201  [0201]
R18377  10K  RESISTOR_0201  [0201]
R18378  10K  RESISTOR_0201  [0201]
R18379  10K  RESISTOR_0201  [0201]
R18380  10K  RESISTOR_0201  [0201]
R18381  10K  RESISTOR_0201  [0201]
R18382  10K  RESISTOR_0201  [0201]
R18383  10K  RESISTOR_0201  [0201]
R18384  10K  RESISTOR_0201  [0201]
R18385  10K  RESISTOR_0201  [0201]
R18386  10K  RESISTOR_0201  [0201]
R18387  10K  RESISTOR_0201  [0201]
R18388  10K  RESISTOR_0201  [0201]
R18389  10K  RESISTOR_0201  [0201]
R18390  10K  RESISTOR_0201  [0201]
R18391  10K  RESISTOR_0201  [0201]
R18392  10K  RESISTOR_0201  [0201]
R18393  10K  RESISTOR_0201  [0201]
R18394  10K  RESISTOR_0201  [0201]
R18395  10K  RESISTOR_0201  [0201]
R18396  10K  RESISTOR_0201  [0201]
R18397  10K  RESISTOR_0201  [0201]
R18398  10K  RESISTOR_0201  [0201]
R18399  10K  RESISTOR_0201  [0201]
R18400  10K  RESISTOR_0201  [0201]
R18401  10K  RESISTOR_0201  [0201]
R18402  10K  RESISTOR_0201  [0201]
R18403  10K  RESISTOR_0201  [0201]
R18404  10K  RESISTOR_0201  [0201]
R18405  10K  RESISTOR_0201  [0201]
R18406  10K  RESISTOR_0201  [0201]
R18407  10K  RESISTOR_0201  [0201]
R18408  10K  RESISTOR_0201  [0201]
R18409  10K  RESISTOR_0201  [0201]
R18410  10K  RESISTOR_0201  [0201]
R18411  10K  RESISTOR_0201  [0201]
R18412  10K  RESISTOR_0201  [0201]
R18413  10K  RESISTOR_0201  [0201]
R18414  10K  RESISTOR_0201  [0201]
R18415  10K  RESISTOR_0201  [0201]
R18416  10K  RESISTOR_0201  [0201]
R18417  10K  RESISTOR_0201  [0201]
R18418  10K  RESISTOR_0201  [0201]
R18419  10K  RESISTOR_0201  [0201]
R18420  10K  RESISTOR_0201  [0201]
R18421  10K  RESISTOR_0201  [0201]
R18422  10K  RESISTOR_0201  [0201]
R18423  10K  RESISTOR_0201  [0201]
R18424  10K  RESISTOR_0201  [0201]
R18425  10K  RESISTOR_0201  [0201]
R18426  10K  RESISTOR_0201  [0201]
R18427  10K  RESISTOR_0201  [0201]
R18428  10K  RESISTOR_0201  [0201]
R18429  10K  RESISTOR_0201  [0201]
R18430  10K  RESISTOR_0201  [0201]
R18431  10K  RESISTOR_0201  [0201]
R18432  10K  RESISTOR_0201  [0201]
R18433  10K  RESISTOR_0201  [0201]
R18434  10K  RESISTOR_0201  [0201]
R18435  10K  RESISTOR_0201  [0201]
R18436  10K  RESISTOR_0201  [0201]
R18437  10K  RESISTOR_0201  [0201]
R18438  10K  RESISTOR_0201  [0201]
R18439  10K  RESISTOR_0201  [0201]
R18440  10K  RESISTOR_0201  [0201]
R18441  10K  RESISTOR_0201  [0201]
R18442  10K  RESISTOR_0201  [0201]
R18443  10K  RESISTOR_0201  [0201]
R18444  10K  RESISTOR_0201  [0201]
R18445  10K  RESISTOR_0201  [0201]
R18446  10K  RESISTOR_0201  [0201]
R18447  10K  RESISTOR_0201  [0201]
R18448  10K  RESISTOR_0201  [0201]
R18449  10K  RESISTOR_0201  [0201]
R18450  10K  RESISTOR_0201  [0201]
R18451  10K  RESISTOR_0201  [0201]
R18452  10K  RESISTOR_0201  [0201]
R18453  10K  RESISTOR_0201  [0201]
R18454  10K  RESISTOR_0201  [0201]
R18455  10K  RESISTOR_0201  [0201]
R18456  10K  RESISTOR_0201  [0201]
R18457  10K  RESISTOR_0201  [0201]
R18458  10K  RESISTOR_0201  [0201]
R18459  10K  RESISTOR_0201  [0201]
R18460  10K  RESISTOR_0201  [0201]
R18461  10K  RESISTOR_0201  [0201]
R18462  10K  RESISTOR_0201  [0201]
R18463  10K  RESISTOR_0201  [0201]
R18464  10K  RESISTOR_0201  [0201]
R18465  10K  RESISTOR_0201  [0201]
R18466  10K  RESISTOR_0201  [0201]
R18467  10K  RESISTOR_0201  [0201]
R18468  10K  RESISTOR_0201  [0201]
R18469  10K  RESISTOR_0201  [0201]
R18470  10K  RESISTOR_0201  [0201]
R18471  10K  RESISTOR_0201  [0201]
R18472  10K  RESISTOR_0201  [0201]
R18473  10K  RESISTOR_0201  [0201]
R18474  10K  RESISTOR_0201  [0201]
R18475  10K  RESISTOR_0201  [0201]
R18476  10K  RESISTOR_0201  [0201]
R18477  10K  RESISTOR_0201  [0201]
R18478  10K  RESISTOR_0201  [0201]
R18479  10K  RESISTOR_0201  [0201]
R18480  10K  RESISTOR_0201  [0201]
R18481  10K  RESISTOR_0201  [0201]
R18482  10K  RESISTOR_0201  [0201]
R18483  10K  RESISTOR_0201  [0201]
R18484  10K  RESISTOR_0201  [0201]
R18485  10K  RESISTOR_0201  [0201]
R18486  10K  RESISTOR_0201  [0201]
R18487  10K  RESISTOR_0201  [0201]
R18488  10K  RESISTOR_0201  [0201]
R18489  10K  RESISTOR_0201  [0201]
R18490  10K  RESISTOR_0201  [0201]
R18491  10K  RESISTOR_0201  [0201]
R18492  10K  RESISTOR_0201  [0201]
R18493  10K  RESISTOR_0201  [0201]
R18494  10K  RESISTOR_0201  [0201]
R18495  10K  RESISTOR_0201  [0201]
R18496  10K  RESISTOR_0201  [0201]
R18497  10K  RESISTOR_0201  [0201]
R18498  10K  RESISTOR_0201  [0201]
R18499  10K  RESISTOR_0201  [0201]
R18500  10K  RESISTOR_0201  [0201]
R18501  10K  RESISTOR_0201  [0201]
R18502  10K  RESISTOR_0201  [0201]
R18503  10K  RESISTOR_0201  [0201]
R18504  10K  RESISTOR_0201  [0201]
R18505  10K  RESISTOR_0201  [0201]
R18506  10K  RESISTOR_0201  [0201]
R18507  10K  RESISTOR_0201  [0201]
R18508  10K  RESISTOR_0201  [0201]
R18509  10K  RESISTOR_0201  [0201]
R18510  10K  RESISTOR_0201  [0201]
R18511  10K  RESISTOR_0201  [0201]
R18512  10K  RESISTOR_0201  [0201]
R18513  10K  RESISTOR_0201  [0201]
R18514  10K  RESISTOR_0201  [0201]
R18515  10K  RESISTOR_0201  [0201]
R18516  10K  RESISTOR_0201  [0201]
R18517  10K  RESISTOR_0201  [0201]
R18518  10K  RESISTOR_0201  [0201]
R18519  10K  RESISTOR_0201  [0201]
R18520  10K  RESISTOR_0201  [0201]
R18521  10K  RESISTOR_0201  [0201]
R18522  10K  RESISTOR_0201  [0201]
R18523  10K  RESISTOR_0201  [0201]
R18524  10K  RESISTOR_0201  [0201]
R18525  10K  RESISTOR_0201  [0201]
R18526  10K  RESISTOR_0201  [0201]
R18527  10K  RESISTOR_0201  [0201]
R18528  10K  RESISTOR_0201  [0201]
R18529  10K  RESISTOR_0201  [0201]
R18530  10K  RESISTOR_0201  [0201]
R18531  10K  RESISTOR_0201  [0201]
R18532  10K  RESISTOR_0201  [0201]
R18533  10K  RESISTOR_0201  [0201]
R18534  10K  RESISTOR_0201  [0201]
R18535  10K  RESISTOR_0201  [0201]
R18536  10K  RESISTOR_0201  [0201]
R18537  10K  RESISTOR_0201  [0201]
R18538  10K  RESISTOR_0201  [0201]
R18539  10K  RESISTOR_0201  [0201]
R18540  10K  RESISTOR_0201  [0201]
R18541  10K  RESISTOR_0201  [0201]
R18542  10K  RESISTOR_0201  [0201]
R18543  10K  RESISTOR_0201  [0201]
R18544  10K  RESISTOR_0201  [0201]
R18545  10K  RESISTOR_0201  [0201]
R18546  10K  RESISTOR_0201  [0201]
R18547  10K  RESISTOR_0201  [0201]
R18548  10K  RESISTOR_0201  [0201]
R18549  10K  RESISTOR_0201  [0201]
R18550  10K  RESISTOR_0201  [0201]
R18551  10K  RESISTOR_0201  [0201]
R18552  10K  RESISTOR_0201  [0201]
R18553  10K  RESISTOR_0201  [0201]
R18554  10K  RESISTOR_0201  [0201]
R18555  10K  RESISTOR_0201  [0201]
R18556  10K  RESISTOR_0201  [0201]
R18557  10K  RESISTOR_0201  [0201]
R18558  10K  RESISTOR_0201  [0201]
R18559  10K  RESISTOR_0201  [0201]
R18560  10K  RESISTOR_0201  [0201]
R18561  10K  RESISTOR_0201  [0201]
R18562  10K  RESISTOR_0201  [0201]
R18563  10K  RESISTOR_0201  [0201]
R18564  10K  RESISTOR_0201  [0201]
R18565  10K  RESISTOR_0201  [0201]
R18566  10K  RESISTOR_0201  [0201]
R18567  10K  RESISTOR_0201  [0201]
R18568  10K  RESISTOR_0201  [0201]
R18569  10K  RESISTOR_0201  [0201]
R18570  10K  RESISTOR_0201  [0201]
R18571  10K  RESISTOR_0201  [0201]
R18572  10K  RESISTOR_0201  [0201]
R18573  10K  RESISTOR_0201  [0201]
R18574  10K  RESISTOR_0201  [0201]
R18575  10K  RESISTOR_0201  [0201]
R18576  10K  RESISTOR_0201  [0201]
R18577  10K  RESISTOR_0201  [0201]
R18578  10K  RESISTOR_0201  [0201]
R18579  10K  RESISTOR_0201  [0201]
R18580  10K  RESISTOR_0201  [0201]
R18581  10K  RESISTOR_0201  [0201]
R18582  10K  RESISTOR_0201  [0201]
R18583  10K  RESISTOR_0201  [0201]
R18584  10K  RESISTOR_0201  [0201]
R18585  10K  RESISTOR_0201  [0201]
R18586  10K  RESISTOR_0201  [0201]
R18587  10K  RESISTOR_0201  [0201]
R18588  10K  RESISTOR_0201  [0201]
R18589  10K  RESISTOR_0201  [0201]
R18590  10K  RESISTOR_0201  [0201]
R18591  10K  RESISTOR_0201  [0201]
R18592  10K  RESISTOR_0201  [0201]
R18593  10K  RESISTOR_0201  [0201]
R18594  10K  RESISTOR_0201  [0201]
R18595  10K  RESISTOR_0201  [0201]
R18596  10K  RESISTOR_0201  [0201]
R18597  10K  RESISTOR_0201  [0201]
R18598  10K  RESISTOR_0201  [0201]
R18599  10K  RESISTOR_0201  [0201]
R18600  10K  RESISTOR_0201  [0201]
R18601  10K  RESISTOR_0201  [0201]
R18602  10K  RESISTOR_0201  [0201]
R18603  10K  RESISTOR_0201  [0201]
R18604  10K  RESISTOR_0201  [0201]
R18605  10K  RESISTOR_0201  [0201]
R18606  10K  RESISTOR_0201  [0201]
R18607  10K  RESISTOR_0201  [0201]
R18608  10K  RESISTOR_0201  [0201]
R18609  10K  RESISTOR_0201  [0201]
R18610  10K  RESISTOR_0201  [0201]
R18611  10K  RESISTOR_0201  [0201]
R18612  10K  RESISTOR_0201  [0201]
R18613  10K  RESISTOR_0201  [0201]
R18614  10K  RESISTOR_0201  [0201]
R18615  10K  RESISTOR_0201  [0201]
R18616  10K  RESISTOR_0201  [0201]
R18617  10K  RESISTOR_0201  [0201]
R18618  10K  RESISTOR_0201  [0201]
R18619  10K  RESISTOR_0201  [0201]
R18620  10K  RESISTOR_0201  [0201]
R18621  10K  RESISTOR_0201  [0201]
R18622  10K  RESISTOR_0201  [0201]
R18623  10K  RESISTOR_0201  [0201]
R18624  10K  RESISTOR_0201  [0201]
R18625  10K  RESISTOR_0201  [0201]
R18626  10K  RESISTOR_0201  [0201]
R18627  10K  RESISTOR_0201  [0201]
R18628  10K  RESISTOR_0201  [0201]
R18629  10K  RESISTOR_0201  [0201]
R18630  10K  RESISTOR_0201  [0201]
R18631  10K  RESISTOR_0201  [0201]
R18632  10K  RESISTOR_0201  [0201]
R18633  10K  RESISTOR_0201  [0201]
R18634  10K  RESISTOR_0201  [0201]
R18635  10K  RESISTOR_0201  [0201]
R18636  10K  RESISTOR_0201  [0201]
R18637  10K  RESISTOR_0201  [0201]
R18638  10K  RESISTOR_0201  [0201]
R18639  10K  RESISTOR_0201  [0201]
R18640  10K  RESISTOR_0201  [0201]
R18641  10K  RESISTOR_0201  [0201]
R18642  10K  RESISTOR_0201  [0201]
R18643  10K  RESISTOR_0201  [0201]
R18644  10K  RESISTOR_0201  [0201]
R18645  10K  RESISTOR_0201  [0201]
R18646  10K  RESISTOR_0201  [0201]
R18647  10K  RESISTOR_0201  [0201]
R18648  10K  RESISTOR_0201  [0201]
R18649  10K  RESISTOR_0201  [0201]
R18650  10K  RESISTOR_0201  [0201]
R18651  10K  RESISTOR_0201  [0201]
R18652  10K  RESISTOR_0201  [0201]
R18653  10K  RESISTOR_0201  [0201]
R18654  10K  RESISTOR_0201  [0201]
R18655  10K  RESISTOR_0201  [0201]
R18656  10K  RESISTOR_0201  [0201]
R18657  10K  RESISTOR_0201  [0201]
R18658  10K  RESISTOR_0201  [0201]
R18659  10K  RESISTOR_0201  [0201]
R18660  10K  RESISTOR_0201  [0201]
R18661  10K  RESISTOR_0201  [0201]
R18662  10K  RESISTOR_0201  [0201]
R18663  10K  RESISTOR_0201  [0201]
R18664  10K  RESISTOR_0201  [0201]
R18665  10K  RESISTOR_0201  [0201]
R18666  10K  RESISTOR_0201  [0201]
R18667  10K  RESISTOR_0201  [0201]
R18668  10K  RESISTOR_0201  [0201]
R18669  10K  RESISTOR_0201  [0201]
R18670  10K  RESISTOR_0201  [0201]
R18671  10K  RESISTOR_0201  [0201]
R18672  10K  RESISTOR_0201  [0201]
R18673  10K  RESISTOR_0201  [0201]
R18674  10K  RESISTOR_0201  [0201]
R18675  10K  RESISTOR_0201  [0201]
R18676  10K  RESISTOR_0201  [0201]
R18677  10K  RESISTOR_0201  [0201]
R18678  10K  RESISTOR_0201  [0201]
R18679  10K  RESISTOR_0201  [0201]
R18680  10K  RESISTOR_0201  [0201]
R18681  10K  RESISTOR_0201  [0201]
R18682  10K  RESISTOR_0201  [0201]
R18683  10K  RESISTOR_0201  [0201]
R18684  10K  RESISTOR_0201  [0201]
R18685  10K  RESISTOR_0201  [0201]
R18686  10K  RESISTOR_0201  [0201]
R18687  10K  RESISTOR_0201  [0201]
R18688  10K  RESISTOR_0201  [0201]
R18689  10K  RESISTOR_0201  [0201]
R18690  10K  RESISTOR_0201  [0201]
R18691  10K  RESISTOR_0201  [0201]
R18692  10K  RESISTOR_0201  [0201]
R18693  10K  RESISTOR_0201  [0201]
R18694  10K  RESISTOR_0201  [0201]
R18695  10K  RESISTOR_0201  [0201]
R18696  10K  RESISTOR_0201  [0201]
R18697  10K  RESISTOR_0201  [0201]
R18698  10K  RESISTOR_0201  [0201]
R18699  10K  RESISTOR_0201  [0201]
R18700  10K  RESISTOR_0201  [0201]
R18701  10K  RESISTOR_0201  [0201]
R18702  10K  RESISTOR_0201  [0201]
R18703  10K  RESISTOR_0201  [0201]
R18704  10K  RESISTOR_0201  [0201]
R18705  10K  RESISTOR_0201  [0201]
R18706  10K  RESISTOR_0201  [0201]
R18707  10K  RESISTOR_0201  [0201]
R18708  10K  RESISTOR_0201  [0201]
R18709  10K  RESISTOR_0201  [0201]
R18710  10K  RESISTOR_0201  [0201]
R18711  10K  RESISTOR_0201  [0201]
R18712  10K  RESISTOR_0201  [0201]
R18713  10K  RESISTOR_0201  [0201]
R18714  10K  RESISTOR_0201  [0201]
R18715  10K  RESISTOR_0201  [0201]
R18716  10K  RESISTOR_0201  [0201]
R18717  10K  RESISTOR_0201  [0201]
R18718  10K  RESISTOR_0201  [0201]
R18719  10K  RESISTOR_0201  [0201]
R18720  10K  RESISTOR_0201  [0201]
R18721  10K  RESISTOR_0201  [0201]
R18722  10K  RESISTOR_0201  [0201]
R18723  10K  RESISTOR_0201  [0201]
R18724  10K  RESISTOR_0201  [0201]
R18725  10K  RESISTOR_0201  [0201]
R18726  10K  RESISTOR_0201  [0201]
R18727  10K  RESISTOR_0201  [0201]
R18728  10K  RESISTOR_0201  [0201]
R18729  10K  RESISTOR_0201  [0201]
R18730  10K  RESISTOR_0201  [0201]
R18731  10K  RESISTOR_0201  [0201]
R18732  10K  RESISTOR_0201  [0201]
R18733  10K  RESISTOR_0201  [0201]
R18734  10K  RESISTOR_0201  [0201]
R18735  10K  RESISTOR_0201  [0201]
R18736  10K  RESISTOR_0201  [0201]
R18737  10K  RESISTOR_0201  [0201]
R18738  10K  RESISTOR_0201  [0201]
R18739  10K  RESISTOR_0201  [0201]
R18740  10K  RESISTOR_0201  [0201]
R18741  10K  RESISTOR_0201  [0201]
R18742  10K  RESISTOR_0201  [0201]
R18743  10K  RESISTOR_0201  [0201]
R18744  10K  RESISTOR_0201  [0201]
R18745  10K  RESISTOR_0201  [0201]
R18746  10K  RESISTOR_0201  [0201]
R18747  10K  RESISTOR_0201  [0201]
R18748  10K  RESISTOR_0201  [0201]
R18749  10K  RESISTOR_0201  [0201]
R18750  10K  RESISTOR_0201  [0201]
R18751  10K  RESISTOR_0201  [0201]
R18752  10K  RESISTOR_0201  [0201]
R18753  10K  RESISTOR_0201  [0201]
R18754  10K  RESISTOR_0201  [0201]
R18755  10K  RESISTOR_0201  [0201]
R18756  10K  RESISTOR_0201  [0201]
R18757  10K  RESISTOR_0201  [0201]